# EasyEDA Pro project foc_opam.eprj, schematic Schematic1
Board Name: Board1; Create Date: 2022-12-13; Page Name: P1; Project Name: foc_opam; Schematic Name: Schematic1; Update Date: 2025-07-29; Company: 重庆三峡学院; Drawed: 颜福兵; Page Size: A4; Reviewed: 颜福兵; Version: V6.0
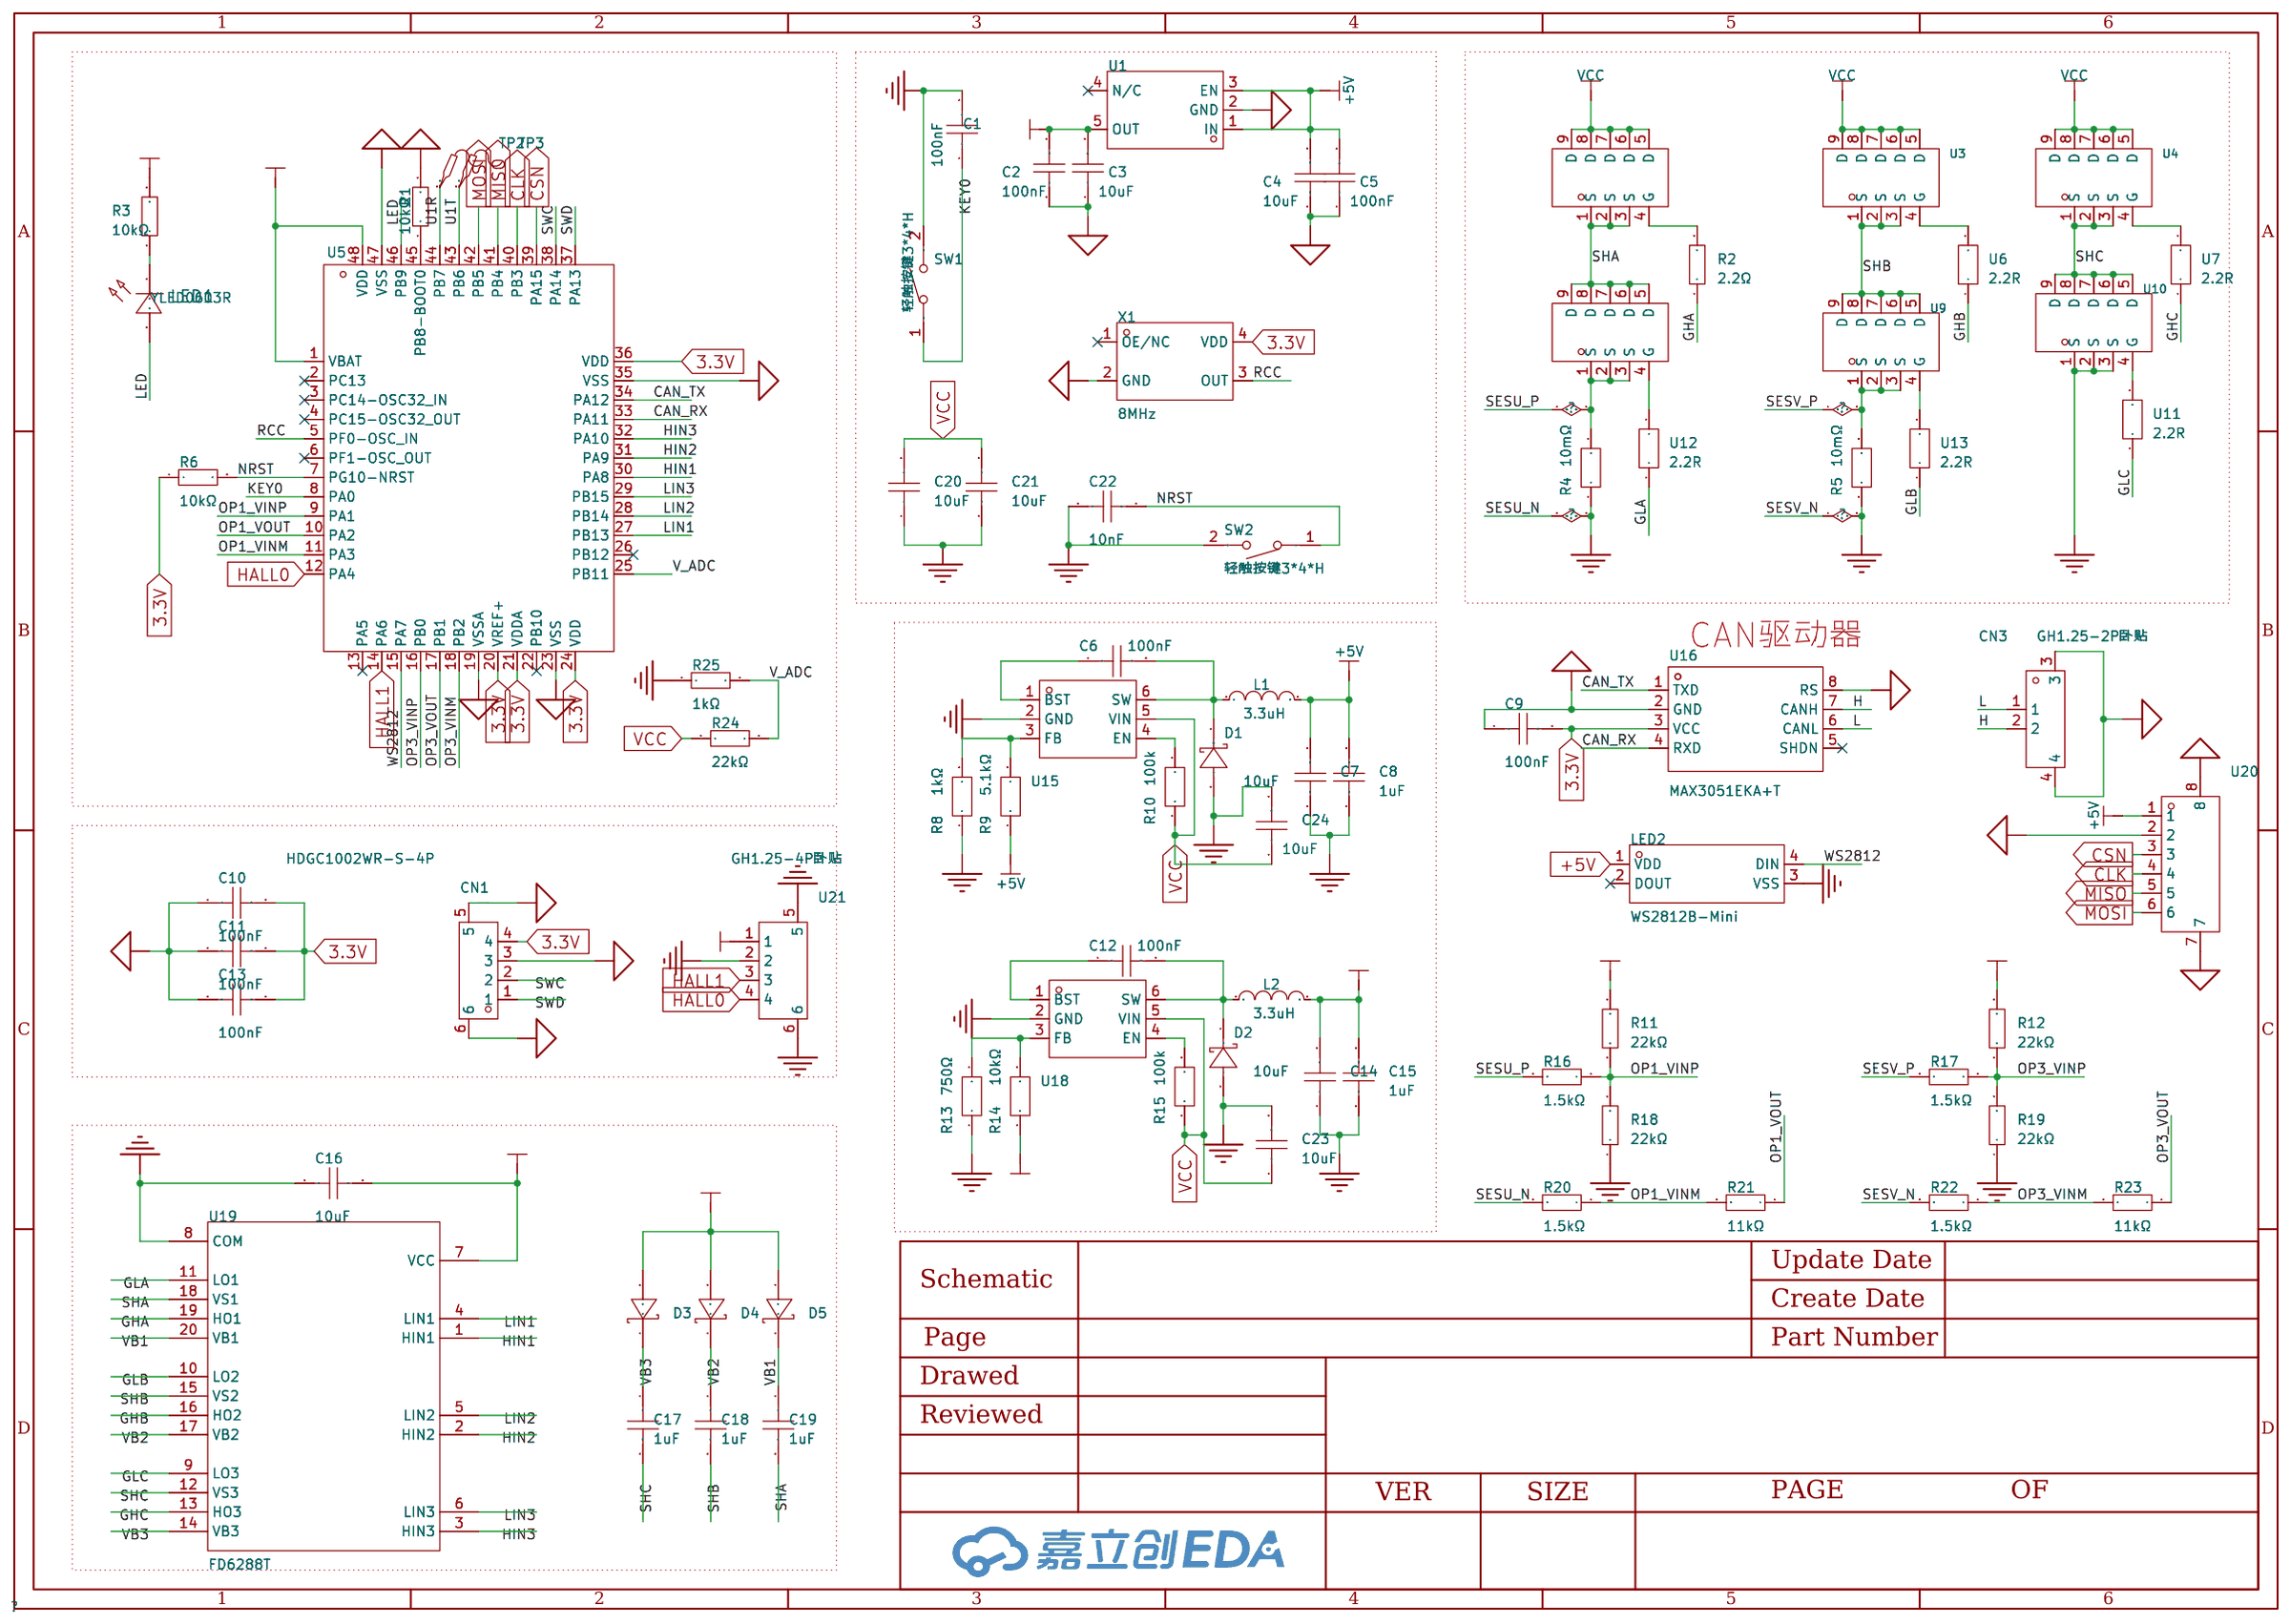
[diagram p0: schematic sheet]

## Parts
C1  100nF  [C0603]
C2  100nF  [C0603]
C3  10uF  [C0603]
C4  10uF  [C0603]
C5  100nF  [C0603]
C6  100nF  [C0603]
C7  10uF  [C0805]
C8  1uF  [C0805]
C9  100nF  [C0603]
C10  100nF  [C0603_1]
C11  100nF  [C0603_1]
C12  100nF  [C0603]
C13  100nF  [C0603_1]
C14  10uF  [C0805]
C15  1uF  [C0805]
C16  10uF  [C0805]
C17  1uF  [C0603]
C18  1uF  [C0603]
C19  1uF  [C0603]
C20  10uF  [C1210]
C21  10uF  [C1210]
C22  10nF  [C0603]
C23  10uF  [C0805]
C24  10uF  [C0805]
CN1  HDGC1002WR-S-4P  [CONN-SMD_4P-P1.00_HDGC_HDGC1002WR-S-4P]
CN3  GH1.25-2P卧贴  [CONN-SMD_2P-P1.25_X1251WRS-02HF-LPSW]
D1  DSK210  [SOD-123FL_L2.7-W1.8-LS3.8-RD]
D2  DSK210  [SOD-123FL_L2.7-W1.8-LS3.8-RD]
D3  B5819WS  [SOD-323_L1.8-W1.3-LS2.5-RD]
D4  B5819WS  [SOD-323_L1.8-W1.3-LS2.5-RD]
D5  B5819WS  [SOD-323_L1.8-W1.3-LS2.5-RD]
L1  3.3uH  [IND-SMD_L4.0-W4.0_SMNR4020]
L2  3.3uH  [IND-SMD_L4.0-W4.0_SMNR4020]
LED1  YLED0603R  [LED_0603]
LED2  WS2812B-Mini  [LED-SMD_4P-L3.5-W3.5-TL_WS2812B]
R1  10kΩ  [R0402]
R2  2.2Ω  [R0603]
R3  10kΩ  [R0402]
R4  10mΩ  [R1206]
R5  10mΩ  [R1206]
R6  10kΩ  [R0402]
R8  1kΩ  [R0603]
R9  5.1kΩ  [R0603]
R10  100k  [R0603]
R11  22kΩ  [R0402]
R12  22kΩ  [R0402]
R13  750Ω  [R0603]
R14  10kΩ  [R0603]
R15  100k  [R0603]
R16  1.5kΩ  [R0402]
R17  1.5kΩ  [R0402]
R18  22kΩ  [R0402]
R19  22kΩ  [R0402]
R20  1.5kΩ  [R0402]
R21  11kΩ  [R0402]
R22  1.5kΩ  [R0402]
R23  11kΩ  [R0402]
R24  22kΩ  [R0402]
R25  1kΩ  [R0402]
SW1  轻触按键3*4*H  [SW-SMD_L4.0-W2.9-LS5.0]
SW2  轻触按键3*4*H  [SW-SMD_L4.0-W2.9-LS5.0]
TP2  -  [Test-Point-0.5mm]
TP3  -  [Test-Point-0.5mm]
U1  -  [SOT-23-5_L3.0-W1.7-P0.95-LS2.8-BR]
U2  CJAC130SN04  [PDFN-8_L5.8-W4.9-P1.27-LS6.1-BL]
U3  CJAC130SN04  [PDFN-8_L5.8-W4.9-P1.27-LS6.1-BL]
U4  CJAC130SN04  [PDFN-8_L5.8-W4.9-P1.27-LS6.1-BL]
U5  STM32G431CBT6  [LQFP-48_L7.0-W7.0-P0.50-LS9.0-BL]
U6  2.2R  [R0603]
U7  2.2R  [R0603]
U8  CJAC130SN04  [PDFN-8_L5.8-W4.9-P1.27-LS6.1-BL]
U9  CJAC130SN04  [PDFN-8_L5.8-W4.9-P1.27-LS6.1-BL]
U10  CJAC130SN04  [PDFN-8_L5.8-W4.9-P1.27-LS6.1-BL]
U11  2.2R  [R0603]
U12  2.2R  [R0603]
U13  2.2R  [R0603]
U15  TD1466TR  [SOT-23-6_L2.9-W1.6-P0.95-LS2.8-BL]
U16  MAX3051EKA+T  [SOT-23-8_L3.0-W1.7-P0.65-LS2.8-TL]
U18  TD1466TR  [SOT-23-6_L2.9-W1.6-P0.95-LS2.8-BL]
U19  FD6288T  [TSSOP-20_L6.5-W4.4-P0.65-LS6.4-BL]
U20  XY-GH1.25-6A61  [CONN-SMD_6P-P1.25_XYECONN_XY-GH1.25-6A61]
U21  GH1.25-4P卧贴  [CONN-SMD_4P-P1.25_GH1.25-4P]
X1  8MHz  [OSC-SMD_4P-L3.2-W2.5-BL]

## Library data of the parts
C1 C2 C5 C6 C9-C13 = CC0603KRX7R9BB104: 容值:100nF;精度:±10%;额定电压:50V;材质(温度系数):X7R;; LCSC Part Name: 100nF ±10% 50V; Supplier Part: C14663; Manufacturer: YAGEO(国巨); Supplier Footprint: 0603; JLCPCB Part Class: Basic Part; Datasheet: https://atta.szlcsc.com/upload/public/pdf/source/20180910/C282072_33301C7F631E79921B82A8DAC6BCC5B3.pdf; Supplier: LCSC; Tolerance: ±10%; Voltage Rated: 50V; Temperature Coefficient: X7R
C3 C4 = CL10A106MA8NRNC: 容值:10uF;精度:±20%;额定电压:25V;材质(温度系数):X5R;; LCSC Part Name: 10uF ±20% 25V; Supplier Part: C96446; Manufacturer: SAMSUNG(三星); Supplier Footprint: 0603; JLCPCB Part Class: Basic Part; Datasheet: https://atta.szlcsc.com/upload/public/pdf/source/20160218/1457707763339.pdf; Supplier: LCSC; Tolerance: ±20%; Voltage Rated: 25V; Temperature Coefficient: X5R
C7 C14 C16 C23 C24 = GRM21BR61H106KE43L: 容值:10uF;精度:±10%;额定电压:50V;材质(温度系数):X5R;; LCSC Part Name: 10uF ±10% 50V; Supplier Part: C440198; Manufacturer: muRata(村田); Supplier Footprint: 0805; JLCPCB Part Class: Basic Part; Datasheet: https://atta.szlcsc.com/upload/public/pdf/source/20230811/95AAE0C9AF55EDC31B7A4D8B733F534E.pdf; Supplier: LCSC; Tolerance: ±10%; Voltage Rated: 50V; Temperature Coefficient: X5R
C8 C15 = CL21B105KBFNNNE: 容值:1uF;精度:±10%;额定电压:50V;材质(温度系数):X7R;; LCSC Part Name: 1uF ±10% 50V; Supplier Part: C28323; Manufacturer: SAMSUNG(三星); Supplier Footprint: 0805; JLCPCB Part Class: Basic Part; Datasheet: https://atta.szlcsc.com/upload/public/pdf/source/20160218/1457707763339.pdf; Supplier: LCSC; Tolerance: ±10%; Voltage Rated: 50V; Temperature Coefficient: X7R
C17-C19 = 0603B105K250NT: 容值:1uF;精度:±10%;额定电压:25V;材质(温度系数):X7R;; LCSC Part Name: 1uF ±10% 25V; Supplier Part: C59302; Manufacturer: FH(风华); Supplier Footprint: 0603; JLCPCB Part Class: Extended Part; Datasheet: https://atta.szlcsc.com/upload/public/pdf/source/20200305/C486355_26A10D38EF8C2A5C37091D0039909270.pdf; Supplier: LCSC; Tolerance: ±10%; Voltage Rated: 25V; Temperature Coefficient: X7R
C20 C21 = FS32X106K101EGG: 容值:10uF;精度:±10%;额定电压:100V;材质(温度系数):X7R;; LCSC Part Name: 10uF ±10% 100V; Supplier Part: C5156756; Manufacturer: PSA(信昌电陶); Supplier Footprint: 1210; JLCPCB Part Class: Extended Part; Datasheet: https://atta.szlcsc.com/upload/public/pdf/source/20220906/2A42A90825742552985FFB5A7BAB200E.pdf; Supplier: LCSC; Tolerance: ±10%; Voltage Rated: 100V; Temperature Coefficient: X7R
C22 = CC0603KRX7R9BB103: 容值:10nF;精度:±10%;额定电压:50V;材质(温度系数):X7R;; LCSC Part Name: 10nF ±10% 50V; Supplier Part: C100042; Manufacturer: YAGEO(国巨); Supplier Footprint: 0603; JLCPCB Part Class: Extended Part; Datasheet: https://atta.szlcsc.com/upload/public/pdf/source/20181008/C309510_22F155564471FAF6A489F7D68F34234E.pdf; Supplier: LCSC; Tolerance: ±10%; Voltage Rated: 50V; Temperature Coefficient: X7R
CN1 = HDGC1002WR-S-4P: 插针结构:1x4P;间距:1mm;安装方式:卧贴;行距:-;总PIN数:4P;排数:1;每排PIN数:4;参考系列:-;额定电流:1A;工作温度范围:-25℃~+70℃;; LCSC Part Name: 1x4P 间距:1mm 卧贴; Supplier Part: C2936214; Manufacturer: HDGC(华德共创); Supplier Footprint: SMD,P=1mm,卧贴; Datasheet: https://atta.szlcsc.com/upload/public/pdf/source/20211229/E8A09E85670B5E97244D2008A24D97FE.pdf; Supplier: LCSC; Pins Structure: 1x4P; Pitch: 1mm; Mounting Style: 卧贴; Number of Pins: 4P; Number of Rows: 1; Number of PINs Per Row: 4; Current Rating (Max): 1A; Operating Temperature Range: -25℃~+70℃
CN3 = GH1.25-2P卧贴_C9900015099: Supplier Part: C9900015099; JLCPCB Part Class: 扩展库; Supplier: LCSC
D1 D2 = DSK210: 二极管配置:-;直流反向耐压(Vr):100V;平均整流电流(Io):2A;正向压降(Vf):850mV@2A;反向电流(Ir):500A@100V;; LCSC Part Name: 100V 2A 850mV@2A; Supplier Part: C713647; Manufacturer: LGE(鲁光); Supplier Footprint: SOD-123FL; Datasheet: https://atta.szlcsc.com/upload/public/pdf/source/20190705/C402239_01B951231737BAE59EAA6E9CB9FE9F09.pdf; Supplier: LCSC; Reverse Voltage (Vr): 100V; Average Rectified Current (Io): 2A; Forward Voltage (Vf@If): 850mV@2A; Reverse Leakage Current (Ir): 500A@100V
D3-D5 = B5819WS_C305446: 直流反向耐压(Vr):40V;平均整流电流(Io):1A;正向压降(Vf):650mV@1A;; LCSC Part Name: 40V 1A 650mV@1A; Supplier Part: C305446; Manufacturer: BLUE ROCKET(蓝箭); Supplier Footprint: SOD-323; JLCPCB Part Class: 扩展库; Datasheet: https://atta.szlcsc.com/upload/public/pdf/source/20181016/C305446_FD4E1DEE0C1770D248180BFC4E4FE3DE.pdf; Supplier: LCSC; Reverse Voltage (Vr): 40V; Average Rectified Current (Io): 1A; Forward Voltage (Vf@If): 650mV@1A
L1 L2 = SMNR4020-3R3MT: 电感值:3.3uH;精度:±20%;额定电流:2.45A;饱和电流(Isat):3.2A;; LCSC Part Name: 3.3uH ±20% 3.2A; Supplier Part: C467060; Manufacturer: SXN(顺翔诺); Supplier Footprint: SMD; JLCPCB Part Class: Extended Part; Datasheet: https://atta.szlcsc.com/upload/public/pdf/source/20210810/9B14FB057739B11AB42B77A310A3EA3C.pdf; Supplier: LCSC; Tolerance: ±20%; Rated Current: 2.45A; Saturation Current (Isat): 3.2A; DC Resistance (DCR): 91mΩ
LED1 = YLED0603R: 发光颜色:红色;正向电压(VF):1.8V~2.4V;功率:-;正向电流:25mA;主波长:620nm~625nm;二极管配置:-;透镜颜色:-;色温:-;发光强度:-;发光角度:-;载带方式:-;工作温度:-40℃~+85℃;; Supplier Part: C19171390; Manufacturer: YONGYUTAI(永裕泰); Supplier Footprint: 0603; JLCPCB Part Class: Extended Part; Datasheet: https://atta.szlcsc.com/upload/public/pdf/source/20231027/FB19AF06E2C70028E58AB5CEDD1BDC72.pdf; Supplier: LCSC; Emitted Color: 红色; Forward Voltage (VF): 1.8V~2.4V; Forward Current: 25mA; Dominant Wavelength: 620nm~625nm; Operating Temperature: -40℃~+85℃
LED2 = WS2812B-Mini: 发光颜色:RGB三色;; Supplier Part: C114583; Manufacturer: worldsemi; Supplier Footprint: SMD3535; JLCPCB Part Class: 扩展库; Datasheet: https://atta.szlcsc.com/upload/public/pdf/source/20190620/C114583_ECCAEB884D1CBA01F5696FFC90F90D84.pdf; Supplier: LCSC; Emitted Color: RGB三色
R1 R3 R6 = RC0402FR-0710KL: 电阻类型:厚膜电阻;阻值:10kΩ;精度:±1%;功率:62.5mW;最大工作电压:50V;温度系数:±100ppm/℃;; LCSC Part Name: 厚膜电阻 10kΩ ±1% 62.5mW; Supplier Part: C60490; Manufacturer: YAGEO(国巨); Supplier Footprint: 0402; JLCPCB Part Class: Extended Part; Datasheet: https://atta.szlcsc.com/upload/public/pdf/source/20170925/C131467_1506321478108990263.pdf; Supplier: LCSC; Type: 厚膜电阻; Tolerance: ±1%; Power(Watts): 62.5mW; Overload Voltage (Max): 50V; Temperature Coefficient: ±100ppm/℃; Operating Temperature Range: -55℃~+155℃
R2 = 0603WAF220KT5E: 电阻类型:厚膜电阻;阻值:2.2Ω;精度:±1%;功率:100mW;最大工作电压:75V;温度系数:±400ppm/℃;; LCSC Part Name: 2.2Ω ±1% 100mW 厚膜电阻; Supplier Part: C22939; Manufacturer: UNI-ROYAL(厚声); Supplier Footprint: 0603; JLCPCB Part Class: Basic Part; Datasheet: https://atta.szlcsc.com/upload/public/pdf/source/20200306/C422600_1E6D84923E4A46A82E41ADD87F860B5C.pdf; Supplier: LCSC; Type: 厚膜电阻; Tolerance: ±1%; Power(Watts): 100mW; Overload Voltage (Max): 75V; Temperature Coefficient: ±400ppm/℃; Operating Temperature Range: -55℃~+155℃
R4 R5 = WSLP1206R0200FEA: 电阻类型:-;额定电流:-;额定压降:-;阻值:20mΩ;精度:±1%;功率:1W;温度系数:±75ppm/℃;安装方式:贴片;; LCSC Part Name: 20mΩ ±1% 1W; Supplier Part: C441558; Manufacturer: VISHAY(威世); Supplier Footprint: 1206; JLCPCB Part Class: Extended Part; Datasheet: https://atta.szlcsc.com/upload/public/pdf/source/20191023/C441558_D0CFF7F9BCE33BB14F28CDD9A0964FA1.pdf; Supplier: LCSC; Tolerance: ±1%; Power(Watts): 1W; Temperature Coefficient: ±75ppm/℃; Mounting Sytle: 贴片
R8 = RC0603FR-071KL: 电阻类型:厚膜电阻;阻值:1kΩ;精度:±1%;功率:100mW;最大工作电压:75V;温度系数:±100ppm/℃;; LCSC Part Name: 厚膜电阻 1kΩ ±1% 100mW; Supplier Part: C22548; Manufacturer: YAGEO(国巨); Supplier Footprint: 0603; JLCPCB Part Class: Extended Part; Datasheet: https://atta.szlcsc.com/upload/public/pdf/source/20180316/70C0E2BDAE7FCC62C531A5A58D202EE1.pdf; Supplier: LCSC; Type: 厚膜电阻; Tolerance: ±1%; Power(Watts): 100mW; Overload Voltage (Max): 75V; Temperature Coefficient: ±100ppm/℃; Operating Temperature Range: -55℃~+155℃
R9 = 0603WAF5101T5E: 电阻类型:厚膜电阻;阻值:5.1kΩ;精度:±1%;功率:100mW;最大工作电压:75V;温度系数:±100ppm/℃;; LCSC Part Name: 5.1kΩ ±1% 100mW 厚膜电阻; Supplier Part: C23186; Manufacturer: UNI-ROYAL(厚声); Supplier Footprint: 0603; JLCPCB Part Class: Basic Part; Datasheet: https://atta.szlcsc.com/upload/public/pdf/source/20200306/C422600_1E6D84923E4A46A82E41ADD87F860B5C.pdf; Supplier: LCSC; Type: 厚膜电阻; Tolerance: ±1%; Power(Watts): 100mW; Overload Voltage (Max): 75V; Temperature Coefficient: ±100ppm/℃; Operating Temperature Range: -55℃~+155℃
R10 R15 U6 U7 U11-U13 = FRC0603J201 TS: 电阻类型:厚膜电阻;阻值:200Ω;精度:±5%;功率:100mW;温度系数:±100ppm/℃;最大工作电压:50V;工作温度范围:-55℃~+155℃;; LCSC Part Name: 200Ω ±5% 100mW; Supplier Part: C2907123; Manufacturer: FOJAN(富捷); Supplier Footprint: 0603; JLCPCB Part Class: Extended Part; Datasheet: https://atta.szlcsc.com/upload/public/pdf/source/20211102/08480A48F159CF742D398A1E4DC90941.pdf; Supplier: LCSC; Type: 厚膜电阻; Tolerance: ±5%; Power(Watts): 100mW; Temperature Coefficient: ±100ppm/℃; Overload Voltage (Max): 50V; Operating Temperature Range: -55℃~+155℃
R11 R12 R18 R19 = 0402WGF2202TCE: 电阻类型:厚膜电阻;阻值:22kΩ;精度:±1%;功率:62.5mW;最大工作电压:50V;温度系数:±100ppm/℃;; LCSC Part Name: 22kΩ ±1% 62.5mW 厚膜电阻; Supplier Part: C25768; Manufacturer: UNI-ROYAL(厚声); Supplier Footprint: 0402; JLCPCB Part Class: Basic Part; Datasheet: https://atta.szlcsc.com/upload/public/pdf/source/20200306/C422600_1E6D84923E4A46A82E41ADD87F860B5C.pdf; Supplier: LCSC; Type: 厚膜电阻; Tolerance: ±1%; Power(Watts): 62.5mW; Overload Voltage (Max): 50V; Temperature Coefficient: ±100ppm/℃; Operating Temperature Range: -55℃~+155℃
R13 = 0603WAF7500T5E: 电阻类型:厚膜电阻;阻值:750Ω;精度:±1%;功率:100mW;最大工作电压:75V;温度系数:±100ppm/℃;; LCSC Part Name: 750Ω ±1% 100mW 厚膜电阻; Supplier Part: C23241; Manufacturer: UNI-ROYAL(厚声); Supplier Footprint: 0603; JLCPCB Part Class: Extended Part; Datasheet: https://atta.szlcsc.com/upload/public/pdf/source/20200306/C422600_1E6D84923E4A46A82E41ADD87F860B5C.pdf; Supplier: LCSC; Type: 厚膜电阻; Tolerance: ±1%; Power(Watts): 100mW; Overload Voltage (Max): 75V; Temperature Coefficient: ±100ppm/℃; Operating Temperature Range: -55℃~+155℃
R14 = 0603WAF1002T5E: 电阻类型:厚膜电阻;阻值:10kΩ;精度:±1%;功率:100mW;最大工作电压:75V;温度系数:±100ppm/℃;; LCSC Part Name: 厚膜电阻 10kΩ ±1% 100mW; Supplier Part: C25804; Manufacturer: UNI-ROYAL(厚声); Supplier Footprint: 0603; JLCPCB Part Class: Basic Part; Datasheet: https://atta.szlcsc.com/upload/public/pdf/source/20200306/C422600_1E6D84923E4A46A82E41ADD87F860B5C.pdf; Supplier: LCSC; Type: 厚膜电阻; Tolerance: ±1%; Power(Watts): 100mW; Overload Voltage (Max): 75V; Temperature Coefficient: ±100ppm/℃; Operating Temperature Range: -55℃~+155℃
R16 R17 R20 R22 = 0402WGF1501TCE: 电阻类型:厚膜电阻;阻值:1.5kΩ;精度:±1%;功率:62.5mW;最大工作电压:50V;温度系数:±100ppm/℃;; LCSC Part Name: 1.5kΩ ±1% 62.5mW 厚膜电阻; Supplier Part: C25867; Manufacturer: UNI-ROYAL(厚声); Supplier Footprint: 0402; JLCPCB Part Class: Basic Part; Datasheet: https://atta.szlcsc.com/upload/public/pdf/source/20200306/C422600_1E6D84923E4A46A82E41ADD87F860B5C.pdf; Supplier: LCSC; Type: 厚膜电阻; Tolerance: ±1%; Power(Watts): 62.5mW; Overload Voltage (Max): 50V; Temperature Coefficient: ±100ppm/℃; Operating Temperature Range: -55℃~+155℃
R21 R23 = 0402WGF1102TCE: 电阻类型:厚膜电阻;阻值:11kΩ;精度:±1%;功率:62.5mW;最大工作电压:50V;温度系数:±100ppm/℃;; LCSC Part Name: 11kΩ ±1% 62.5mW 厚膜电阻; Supplier Part: C25749; Manufacturer: UNI-ROYAL(厚声); Supplier Footprint: 0402; JLCPCB Part Class: Extended Part; Datasheet: https://atta.szlcsc.com/upload/public/pdf/source/20200306/C422600_1E6D84923E4A46A82E41ADD87F860B5C.pdf; Supplier: LCSC; Type: 厚膜电阻; Tolerance: ±1%; Power(Watts): 62.5mW; Overload Voltage (Max): 50V; Temperature Coefficient: ±100ppm/℃; Operating Temperature Range: -55℃~+155℃
R24 = 0402WGF1202TCE: 电阻类型:厚膜电阻;阻值:12kΩ;精度:±1%;功率:62.5mW;最大工作电压:50V;温度系数:±100ppm/℃;; LCSC Part Name: 12kΩ ±1% 62.5mW 厚膜电阻; Supplier Part: C25752; Manufacturer: UNI-ROYAL(厚声); Supplier Footprint: 0402; JLCPCB Part Class: Basic Part; Datasheet: https://atta.szlcsc.com/upload/public/pdf/source/20200306/C422600_1E6D84923E4A46A82E41ADD87F860B5C.pdf; Supplier: LCSC; Type: 厚膜电阻; Tolerance: ±1%; Power(Watts): 62.5mW; Overload Voltage (Max): 50V; Temperature Coefficient: ±100ppm/℃; Operating Temperature Range: -55℃~+155℃
R25 = 0402WGF1001TCE: 电阻类型:厚膜电阻;阻值:1kΩ;精度:±1%;功率:62.5mW;最大工作电压:50V;温度系数:±100ppm/℃;; LCSC Part Name: 1kΩ ±1% 62.5mW 厚膜电阻; Supplier Part: C11702; Manufacturer: UNI-ROYAL(厚声); Supplier Footprint: 0402; JLCPCB Part Class: Basic Part; Datasheet: https://atta.szlcsc.com/upload/public/pdf/source/20200306/C422600_1E6D84923E4A46A82E41ADD87F860B5C.pdf; Supplier: LCSC; Type: 厚膜电阻; Tolerance: ±1%; Power(Watts): 62.5mW; Overload Voltage (Max): 50V; Temperature Coefficient: ±100ppm/℃; Operating Temperature Range: -55℃~+155℃
SW1 SW2 = 轻触按键3*4*H: Supplier Part: C9900017573; Supplier Footprint: 轻触按键3*4*2.5; JLCPCB Part Class: 扩展库; Datasheet: https://atta.szlcsc.comnull; Supplier: LCSC
TP2 TP3 = Test-Point: Test Point 测试点
U1 = LP5907MFX-3.3/NOPB: 输出类型:固定;输出极性:正;输出通道数:1;最大输入电压:5.5V;输出电压:3.3V;压差:250mV@(250mA);输出电流:250mA;电源纹波抑制比(PRSS):90dB@(100Hz),60dB@(100kHz);; LCSC Part Name: Vin=5.5V Vout=3.3V 250mA 90dB@(100Hz),60dB@(100kHz); Supplier Part: C80670; Manufacturer: TI(德州仪器); Supplier Footprint: SOT-23-5; JLCPCB Part Class: Extended Part; Datasheet: https://atta.szlcsc.com/upload/public/pdf/source/20160830/1472551528598.pdf; Supplier: LCSC; Output Type: 固定; Output Polarity: 正; Number of Outputs: 1; Maximum Input Voltage: 5.5V; Output Voltage: 3.3V; Dropout Voltage: 250mV@(250mA); Output Current: 250mA; Power Supply Rejection Ratio (PRSS): 90dB@(100Hz),60dB@(100kHz)
U2-U4 U8-U10 = CJAC130SN04: Supplier Part: C2910051; Manufacturer: CJ(江苏长电/长晶); Supplier Footprint: PDFN-8(4.9x5.8); JLCPCB Part Class: Extended Part; Supplier: LCSC
U5 = STM32G431CBT6: Supplier Part: C529355; Manufacturer: ST(意法半导体); Supplier Footprint: LQFP-48; JLCPCB Part Class: 扩展库; Datasheet: https://atta.szlcsc.com/upload/public/pdf/source/20200511/C529354_7C66CF00837B904D0C15DCE45B69418C.pdf; Supplier: LCSC
U15 U18 = TD1466TR: 交换机 舞台灯光 大厦夜景灯条; LCSC Part Name: 耐压60V 800MA降压DC DC; Supplier Part: C397878; Manufacturer: Techcode(泰德); Supplier Footprint: SOT-23-6; Datasheet: https://atta.szlcsc.com/upload/public/pdf/source/20190618/C397878_834A1A7EFEA624A03A82CCA070811B7F.pdf; Supplier: LCSC
U16 = MAX3051EKA+T: 类型:收发器;数据速率:1Mbps;; LCSC Part Name: 1Mbps 3.14V~3.47V; Supplier Part: C112005; Manufacturer: ADI(亚德诺); Supplier Footprint: SOT-23-8; JLCPCB Part Class: 扩展库; Datasheet: https://atta.szlcsc.com/upload/public/pdf/source/20171014/C112005_15079752662991037925.pdf; Supplier: LCSC; Type: 收发器; Data Rate: 1Mbps; Supply Voltage: 3.14V~3.47V
U19 = FD6288T: 三个独立的半桥栅极驱动集成电路芯片; Supplier Part: C97683; Manufacturer: Fortior Tech(峰岹); Supplier Footprint: TSSOP-20; JLCPCB Part Class: 扩展库; Datasheet: https://atta.szlcsc.com/upload/public/pdf/source/20180912/C97683_ECE58C9DF7F061C95E95DF4276B152DC.pdf; Supplier: LCSC
U20 = XY-GH1.25-6A61: 插针结构:1x6P;间距:1.25mm;安装方式:卧贴;总PIN数:6P;排数:1;每排PIN数:6;行距:2mm;; LCSC Part Name: 间距:1.25mm 1x6P 卧贴 带扣; Supplier Part: C19272063; Manufacturer: XYECONN(辛译); Supplier Footprint: SMD,P=1.25mm,卧贴; JLCPCB Part Class: 扩展库; Datasheet: https://atta.szlcsc.com/upload/public/pdf/source/20231128/F7FA5B8B29E8FE9C6005F4DAEBFEB22D.pdf; Supplier: LCSC; Pins Structure: 1x6P; Pitch: 1.25mm; Mounting Style: 卧贴; Number of Pins: 6P; Number of Rows: 1; Number of PINs Per Row: 6; Row Spacing: 2mm
U21 = GH1.25-4P卧贴: Supplier Part: C9900014670; JLCPCB Part Class: 扩展库; Supplier: LCSC
X1 = CO32H4-12.000-WPJHPSN: 频率:12MHz;频率稳定度:±30ppm;工作电压:1.8V~3.3V;输出模式:HCMOS;工作温度:-20℃~+70℃;; LCSC Part Name: HCMOS 12MHz 1.8V~3.3V ±30ppm; Supplier Part: C2848216; Manufacturer: HCI(杭晶); Supplier Footprint: SMD3225-4P; JLCPCB Part Class: Extended Part; Datasheet: https://atta.szlcsc.com/upload/public/pdf/source/20220525/B926948FC129C170F991EA6FAC6092C6.pdf; Supplier: LCSC; Frequency Stability: ±30ppm; Supply Voltage: 1.8V~3.3V; Output Type: HCMOS; Operating Temperature: -20℃~+70℃

## Nets
3.3V: C2.2 C3.2 C9.2 C10.2 C11.2 C13.2 CN1.4 R3.2 R6.1 R11.2 R12.2 U1.5(OUT) U5.1(VBAT) U5.20(VREF+) U5.21(VDDA) U5.24(VDD) U5.36(VDD) U5.48(VDD) U16.3(VCC) U21.1 X1.4(VDD)
+5V: C4.2 C5.2 C7.2 C8.2 L1.2 LED2.1(VDD) R9.1 U1.1(IN) U1.3(EN) U20.1
+12V: C14.2 C15.2 C16.2 D3.2 D4.2 D5.2 L2.2 R14.1 U19.7(VCC)
GND: C1.2 C2.1 C3.1 C4.1 C5.1 C7.1 C8.1 C9.1 C10.1 C11.1 C13.1 C14.1 C15.1 C16.1 C20.1 C21.1 C22.2 C23.2 C24.2 CN1.3 CN1.5 CN1.6 CN3.3 CN3.4 D1.2(A) D2.2(A) LED2.3(VSS) R1.2 R4.1 R5.1 R8.1 R13.1 R18.1 R19.1 R20.2 R22.2 R25.1 SW1.2 SW2.2 U1.2(GND) U5.19(VSSA) U5.23(VSS) U5.35(VSS) U5.47(VSS) U10.1(S) U10.2(S) U10.3(S) U15.2(GND) U16.2(GND) U16.8(RS) U18.2(GND) U19.8(COM) U20.2 U20.7 U20.8 U21.2 U21.5 U21.6 X1.2(GND)
VCC: C20.2 C21.2 C23.1 C24.1 R10.1 R15.1 R24.1 U2.5(D) U2.6(D) U2.7(D) U2.8(D) U2.9(D) U3.5(D) U3.6(D) U3.7(D) U3.8(D) U3.9(D) U4.5(D) U4.6(D) U4.7(D) U4.8(D) U4.9(D) U15.5(VIN) U18.5(VIN)
CAN_RX: U5.33(PA11) U16.4(RXD)
CAN_TX: U5.34(PA12) U16.1(TXD)
CLK: U5.40(PB3) U20.4
CSN: U5.39(PA15) U20.3
GHA: R2.1 U19.19(HO1)
GHB: U6.1 U19.16(HO2)
GHC: U7.1 U19.13(HO3)
GLA: U12.1 U19.11(LO1)
GLB: U13.1 U19.10(LO2)
GLC: U11.1 U19.9(LO3)
H: CN3.2 U16.7(CANH)
HALL0: U5.12(PA4) U21.4
HALL1: U5.14(PA6) U21.3
HIN1: U5.30(PA8) U19.1(HIN1)
HIN2: U5.31(PA9) U19.2(HIN2)
HIN3: U5.32(PA10) U19.3(HIN3)
KEY0: C1.1 SW1.1 U5.8(PA0)
L: CN3.1 U16.6(CANL)
LED: LED1.2(A) U5.46(PB9)
LIN1: U5.27(PB13) U19.4(LIN1)
LIN2: U5.28(PB14) U19.5(LIN2)
LIN3: U5.29(PB15) U19.6(LIN3)
MISO: U5.41(PB4) U20.5
MOSI: U5.42(PB5) U20.6
NRST: C22.1 R6.2 SW2.1 U5.7(PG10-NRST)
OP1_VINM: R20.1 R21.2 U5.11(PA3)
OP1_VINP: R11.1 R16.1 R18.2 U5.9(PA1)
OP1_VOUT: R21.1 U5.10(PA2)
OP3_VINM: R22.1 R23.2 U5.18(PB2)
OP3_VINP: R12.1 R17.1 R19.2 U5.16(PB0)
OP3_VOUT: R23.1 U5.17(PB1)
RCC: U5.5(PF0-OSC_IN) X1.3(OUT)
SESU_P: R4.2 R16.2 U8.1(S) U8.2(S) U8.3(S)
SESV_P: R5.2 R17.2 U9.1(S) U9.2(S) U9.3(S)
SHA: C19.2 U2.1(S) U2.2(S) U2.3(S) U8.5(D) U8.6(D) U8.7(D) U8.8(D) U8.9(D) U19.18(VS1)
SHB: C18.2 U3.1(S) U3.2(S) U3.3(S) U9.5(D) U9.6(D) U9.7(D) U9.8(D) U9.9(D) U19.15(VS2)
SHC: C17.2 U4.1(S) U4.2(S) U4.3(S) U10.5(D) U10.6(D) U10.7(D) U10.8(D) U10.9(D) U19.12(VS3)
SWC: CN1.2 U5.38(PA14)
SWD: CN1.1 U5.37(PA13)
U1R: TP2.1 U5.44(PB7)
U1T: TP3.1 U5.43(PB6)
V_ADC: R24.2 R25.2 U5.25(PB11)
VB1: C19.1 D5.1 U19.20(VB1)
VB2: C18.1 D4.1 U19.17(VB2)
VB3: C17.1 D3.1 U19.14(VB3)
WS2812: LED2.4(DIN) U5.15(PA7)
$1N2430: R15.2 U18.4(EN)
$1N2434: C12.1 U18.1(BST)
$1N2435: C12.2 D2.1(C) L2.1 U18.6(SW)
$1N2440: R13.2 R14.2 U18.3(FB)
$1N5416: U8.4(G) U12.2
$1N5594: R2.2 U2.4(G)
$1N5708: U9.4(G) U13.2
$1N5922: U3.4(G) U6.2
$1N6055: U10.4(G) U11.2
$1N6187: U4.4(G) U7.2
$1N8102: R10.2 U15.4(EN)
$1N8110: C6.1 U15.1(BST)
$1N8111: C6.2 D1.1(C) L1.1 U15.6(SW)
$1N8122: R8.2 R9.2 U15.3(FB)
$1N34157: R1.1 U5.45(PB8-BOOT0)
$1N46388: LED1.1(C) R3.1

Not connected (* = marked no-connect by the designer): LED2 2(DOUT)*; U1 4(N/C)*; U5 2(PC13)* 3(PC14-OSC32_IN)* 4(PC15-OSC32_OUT)* 6(PF1-OSC_OUT)* 13(PA5)* 22(PB10)* 26(PB12)*; U16 5(SHDN)*; X1 1(OE/NC)*

## Notes on the sheet
- CAN驱动器
